# Altium schematic sheet 0222_GPU POWER_ VCCGT.SchDoc
size 848 x 558 mm
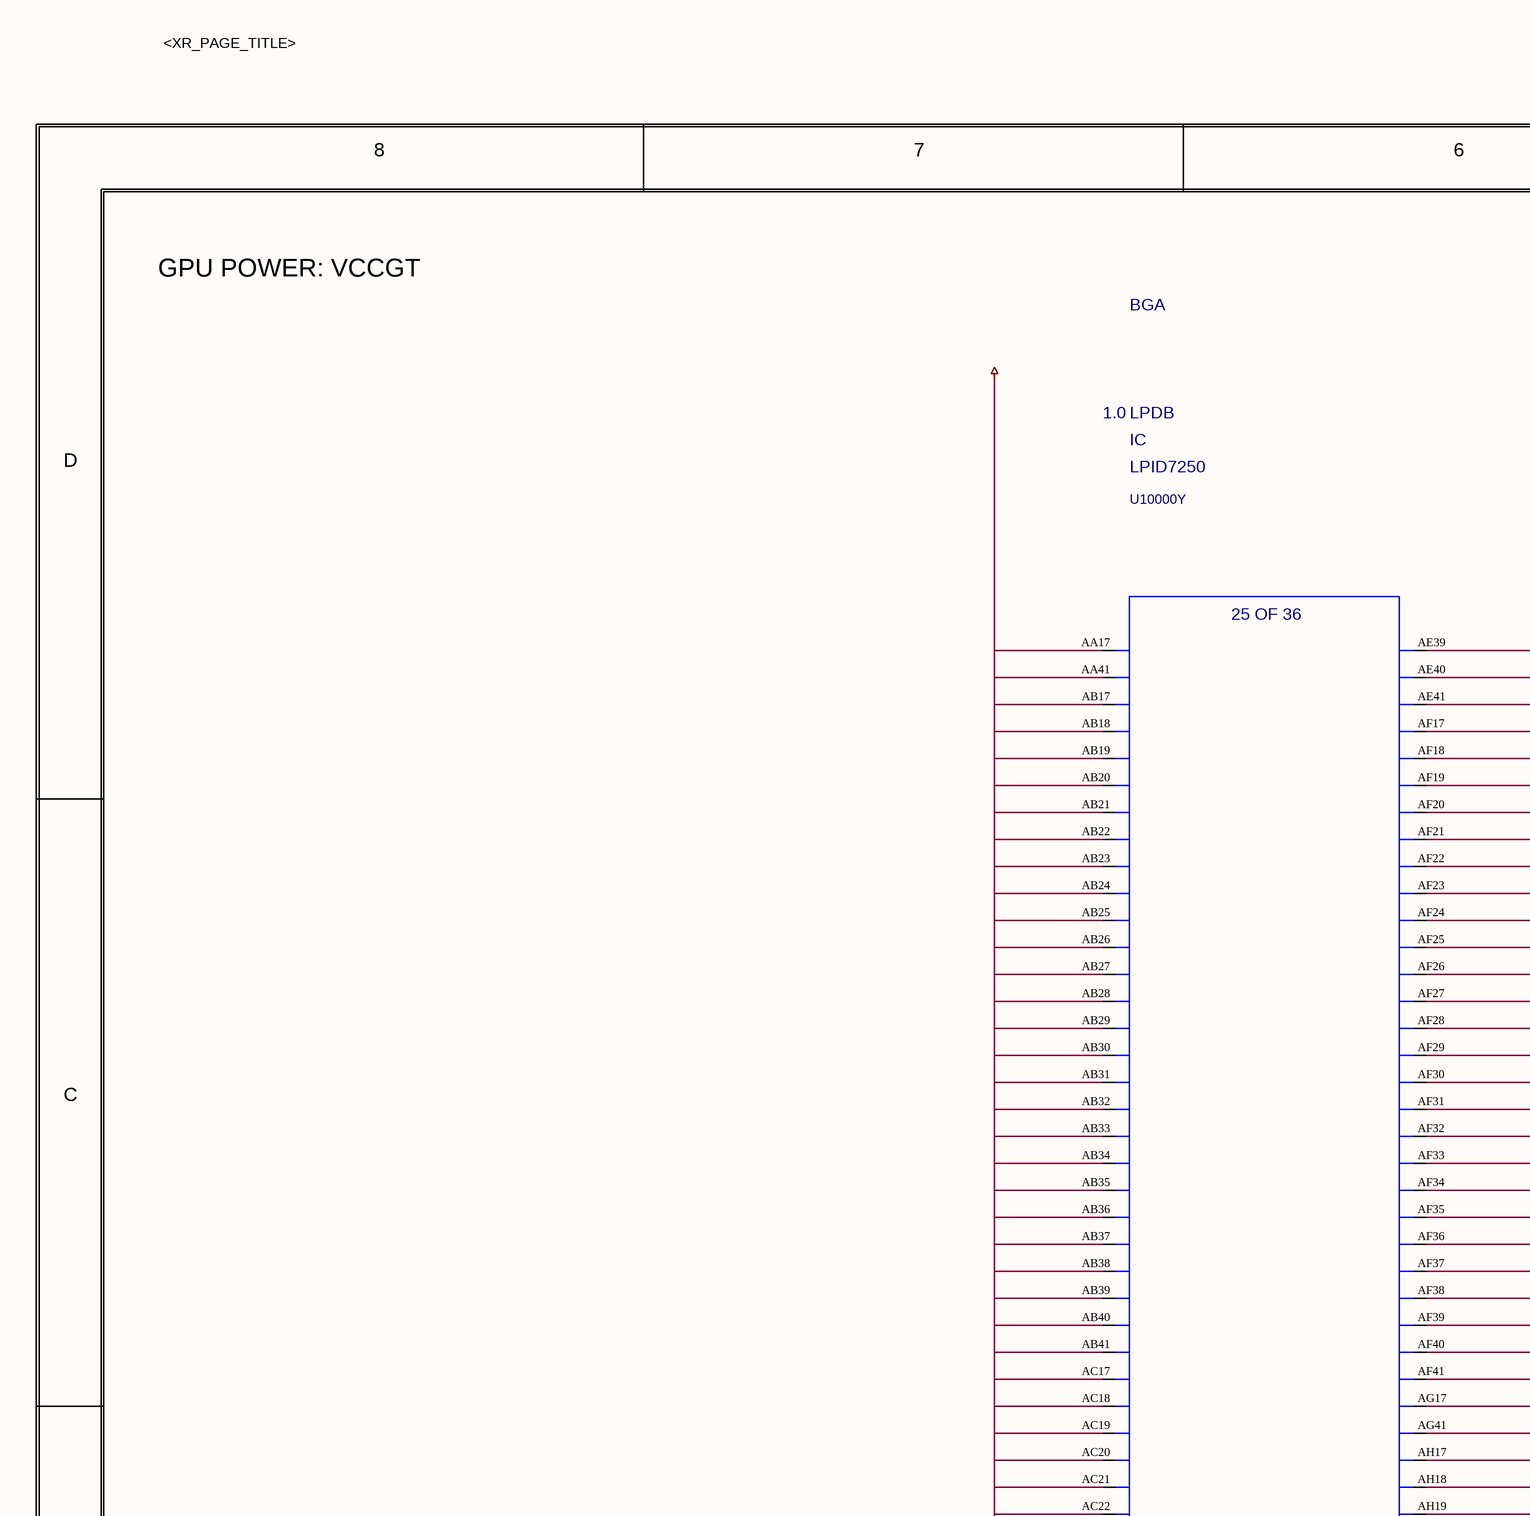
[diagram p0: 0222_GPU POWER_ VCCGT.SchDoc, top left]
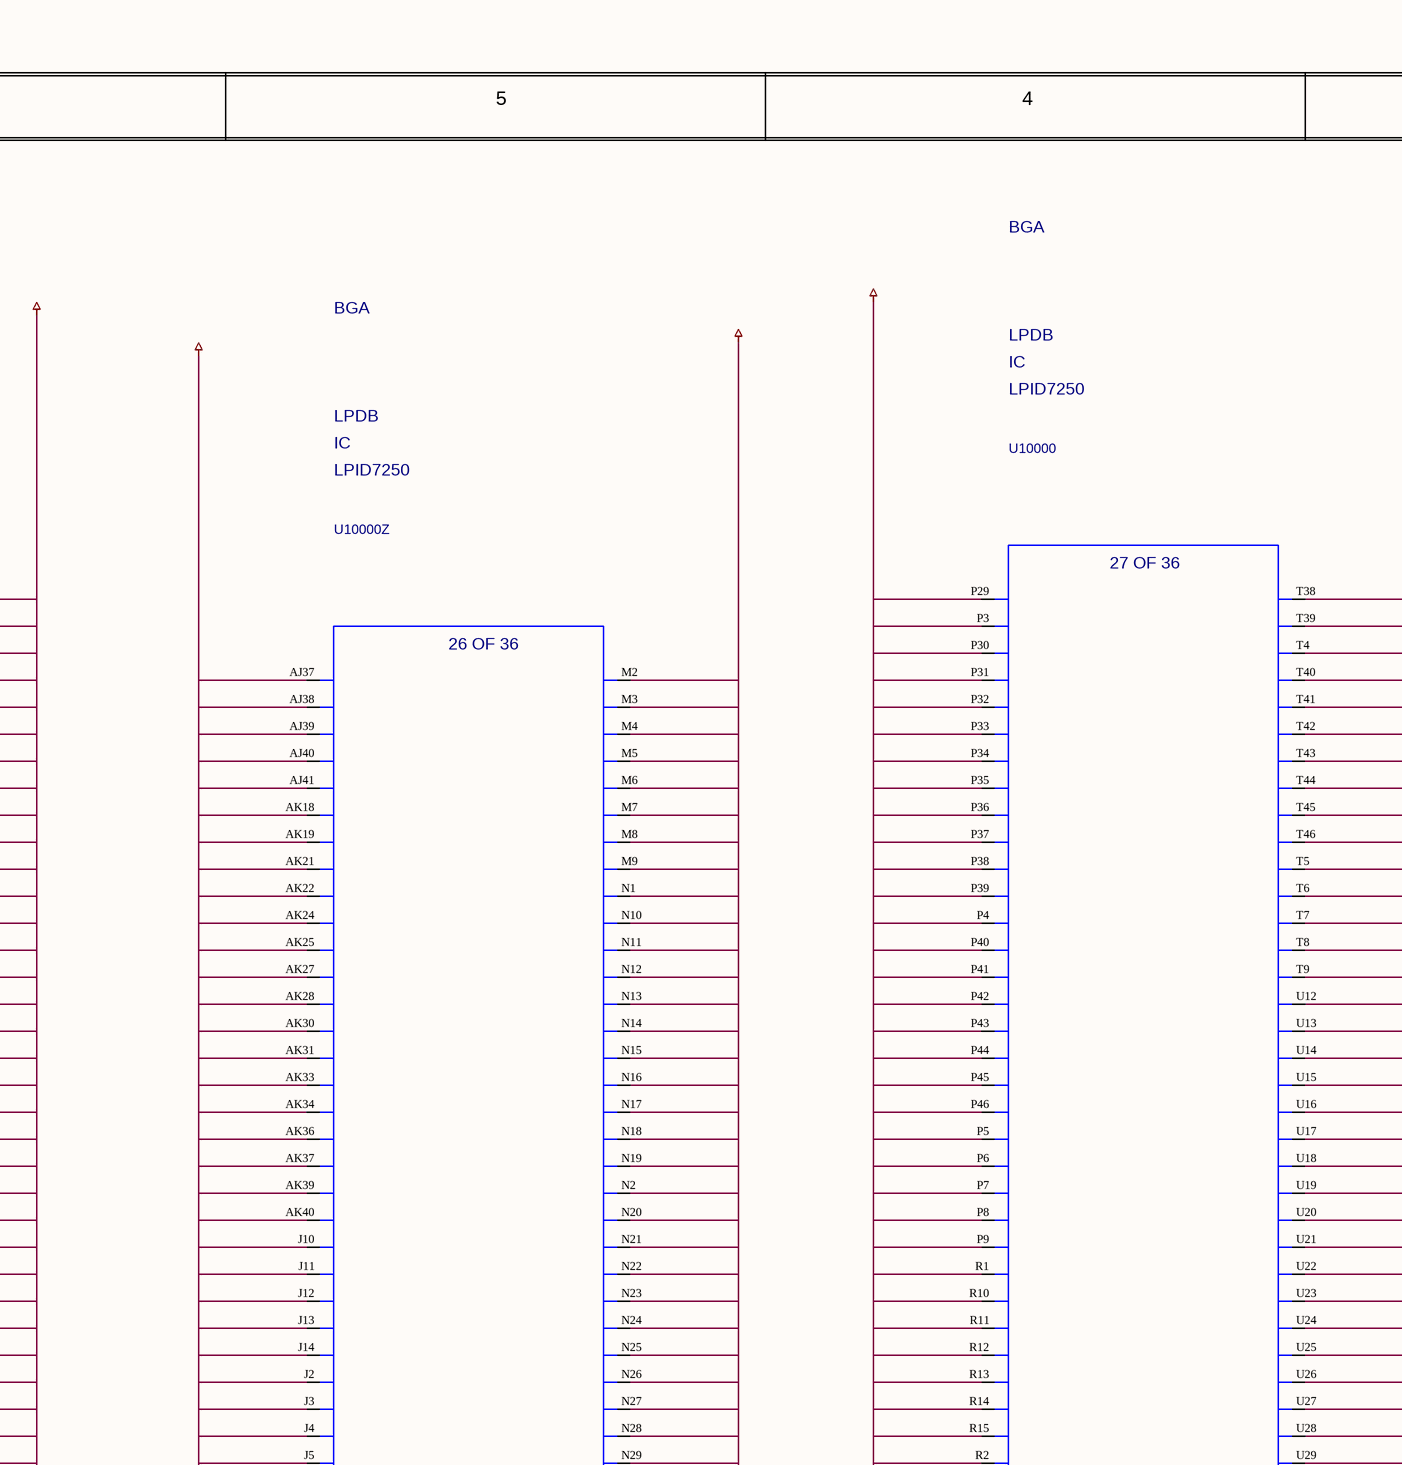
[diagram p1: 0222_GPU POWER_ VCCGT.SchDoc, top middle]
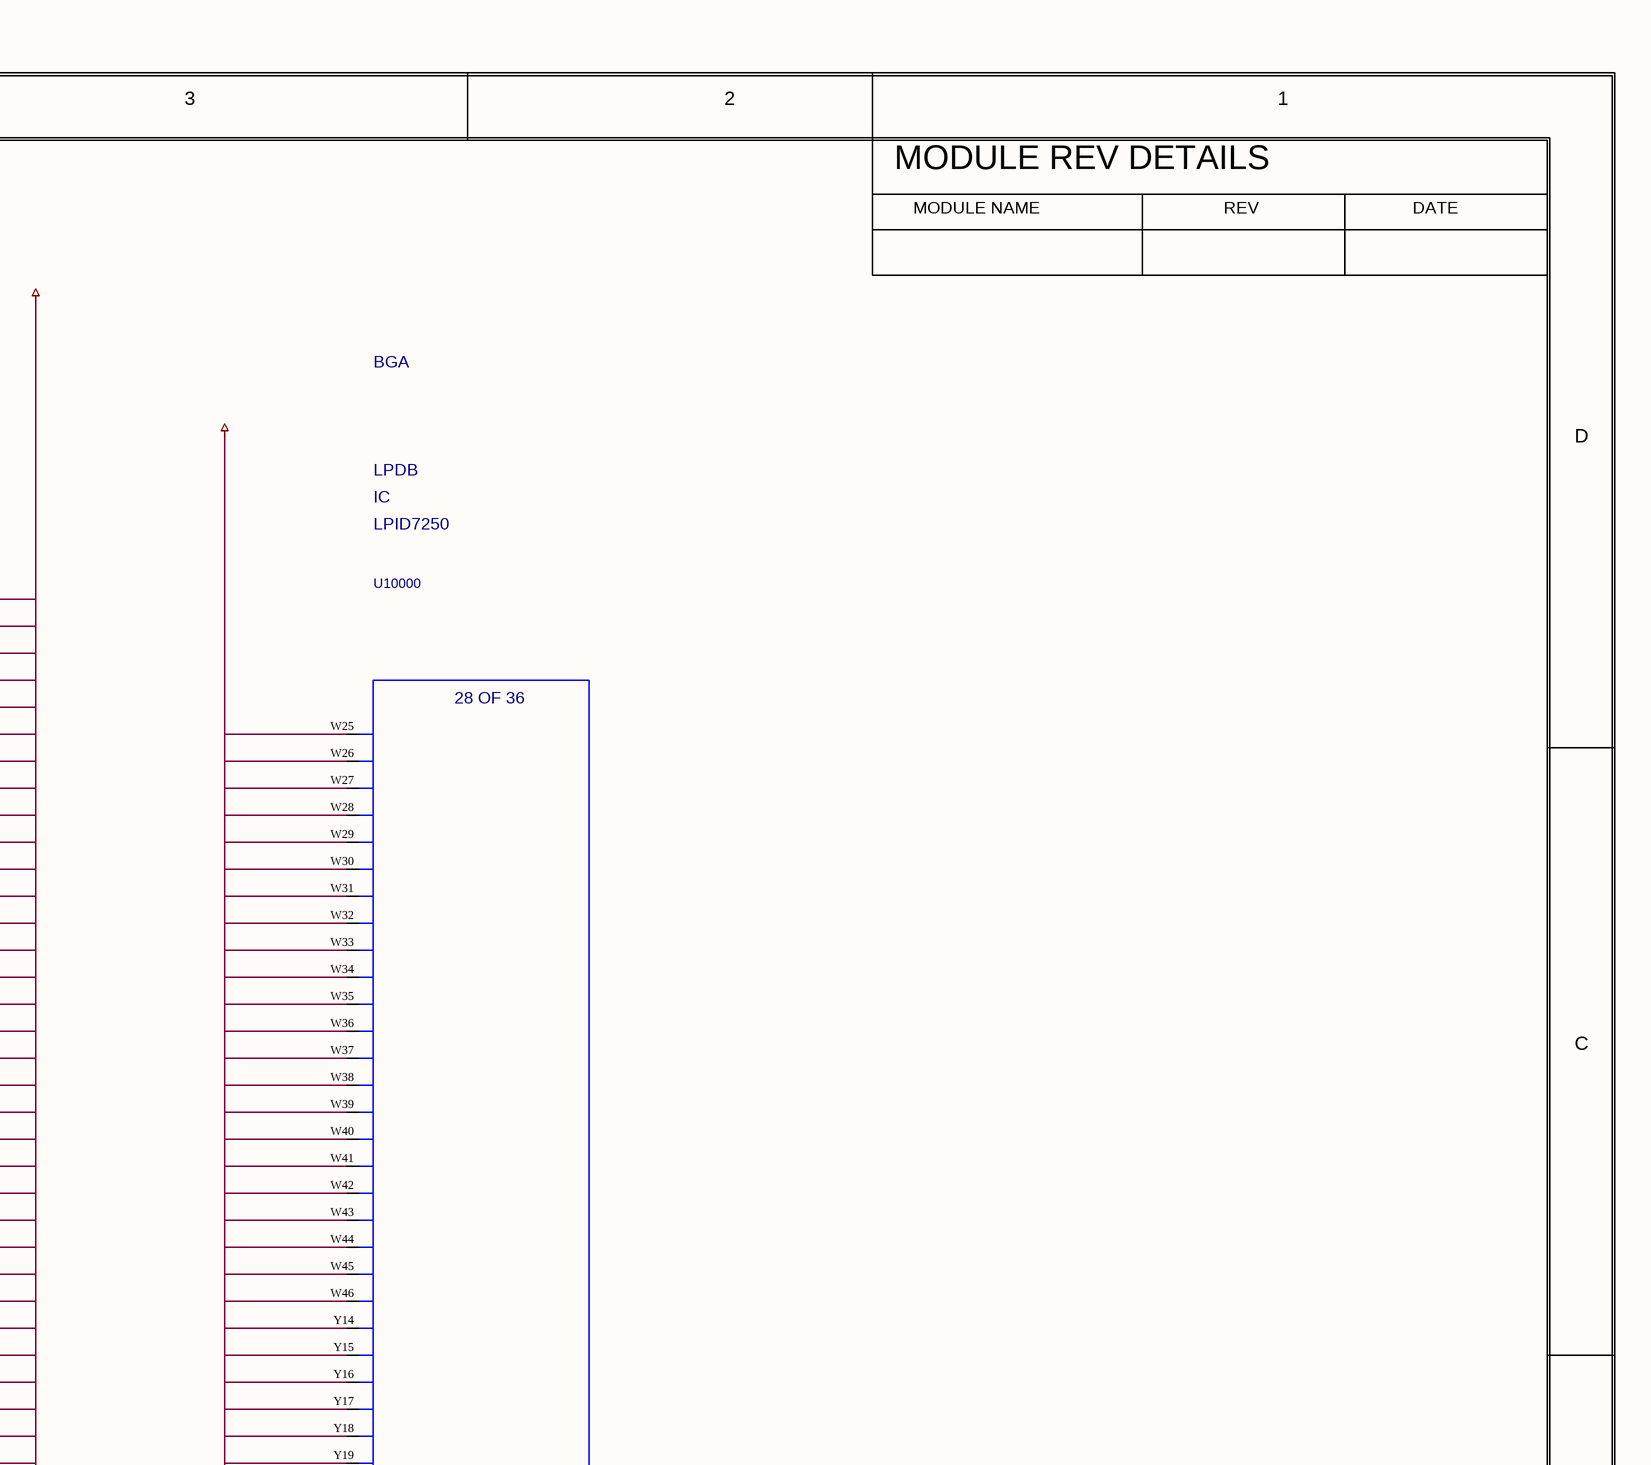
[diagram p2: 0222_GPU POWER_ VCCGT.SchDoc, top right]
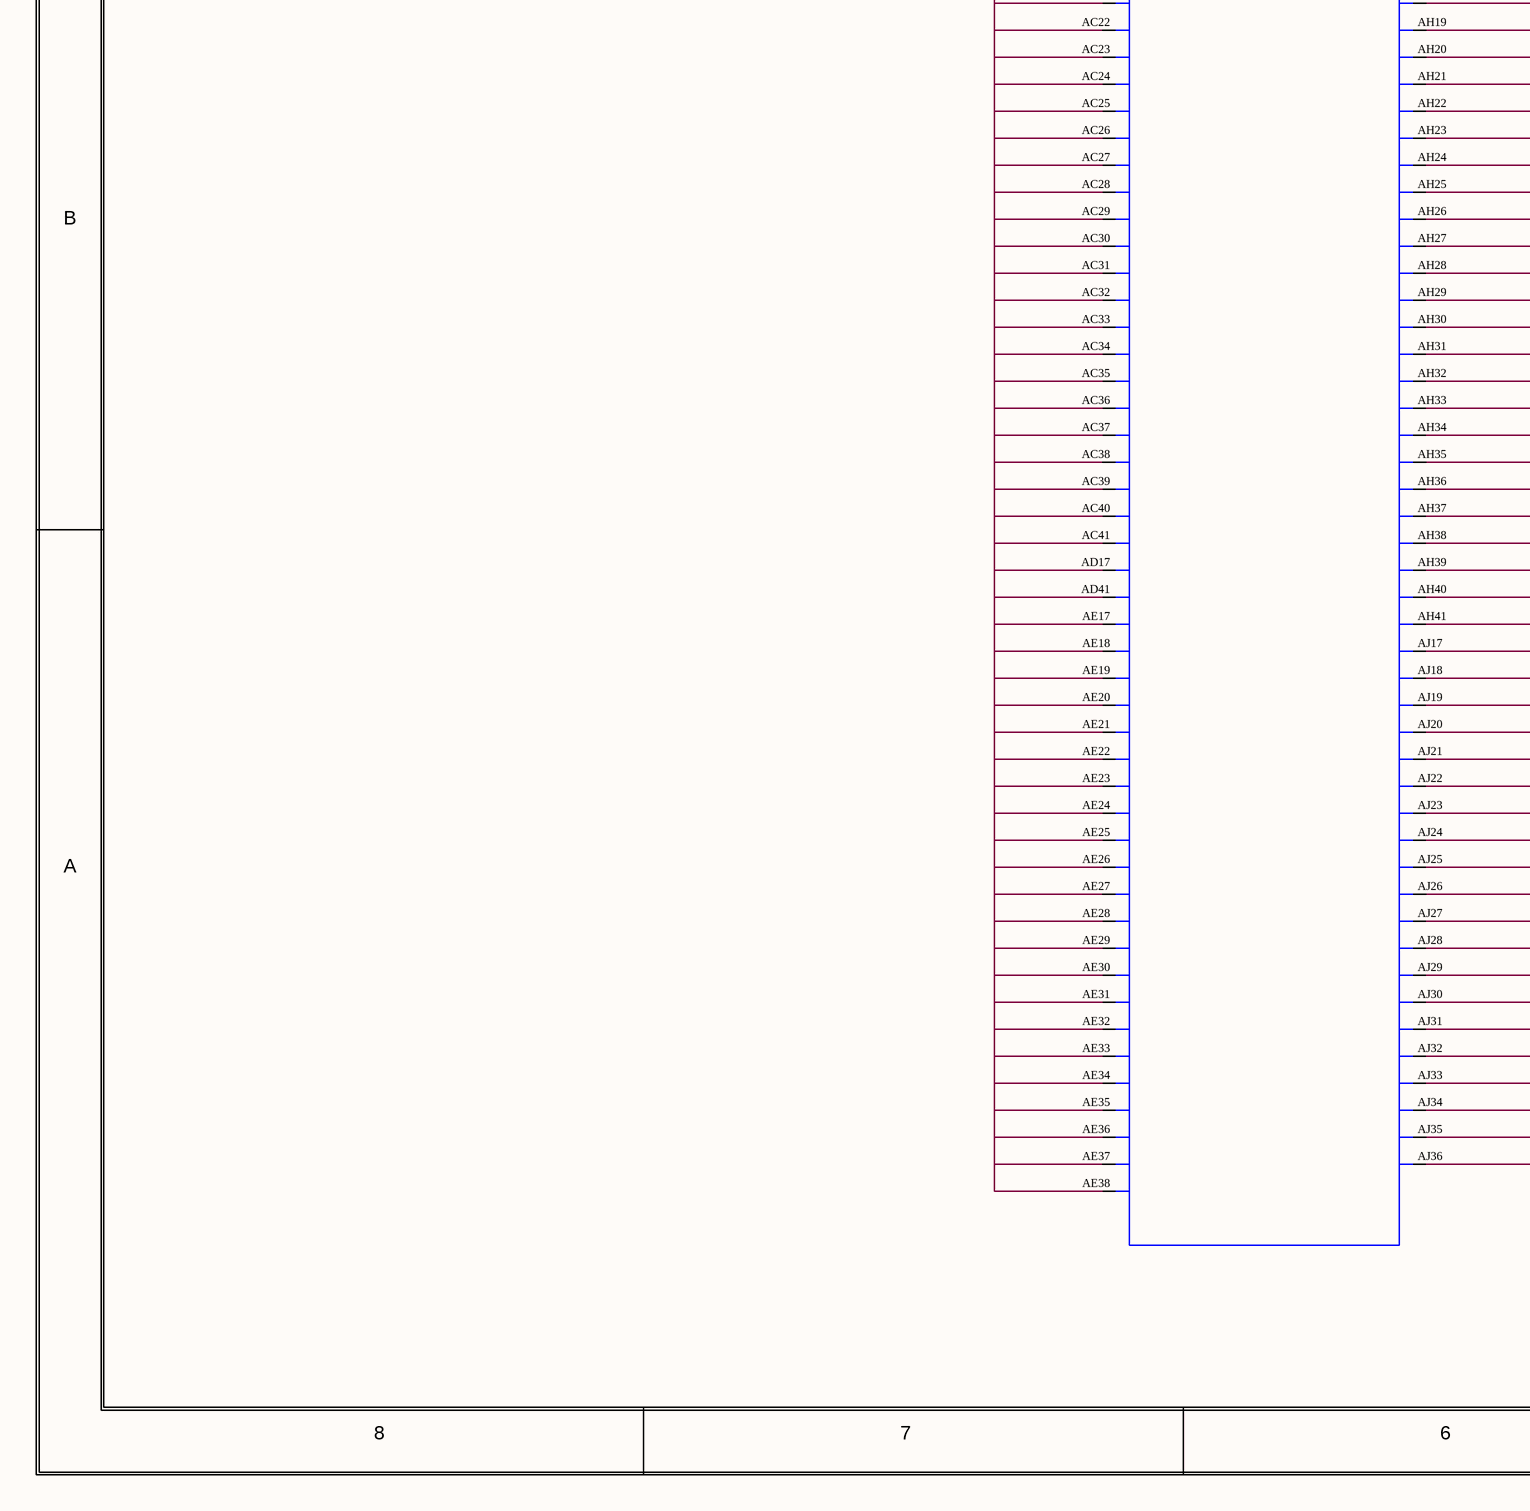
[diagram p3: 0222_GPU POWER_ VCCGT.SchDoc, bottom left]
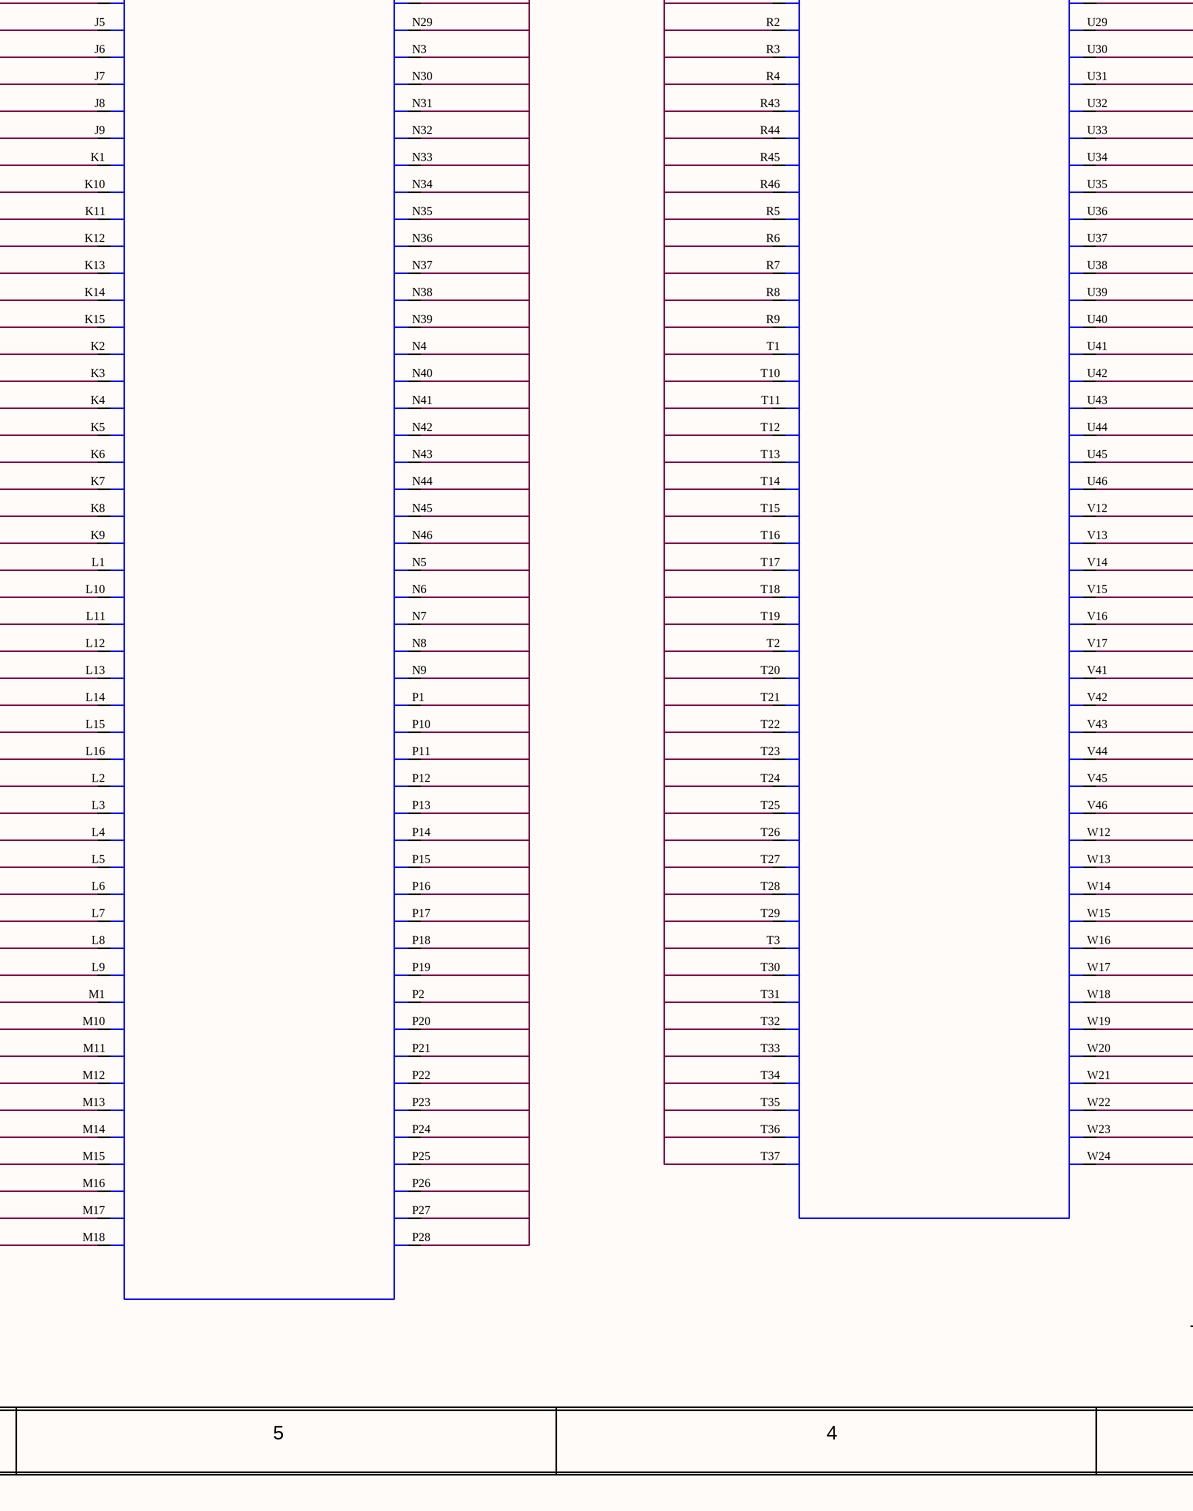
[diagram p4: 0222_GPU POWER_ VCCGT.SchDoc, bottom middle]
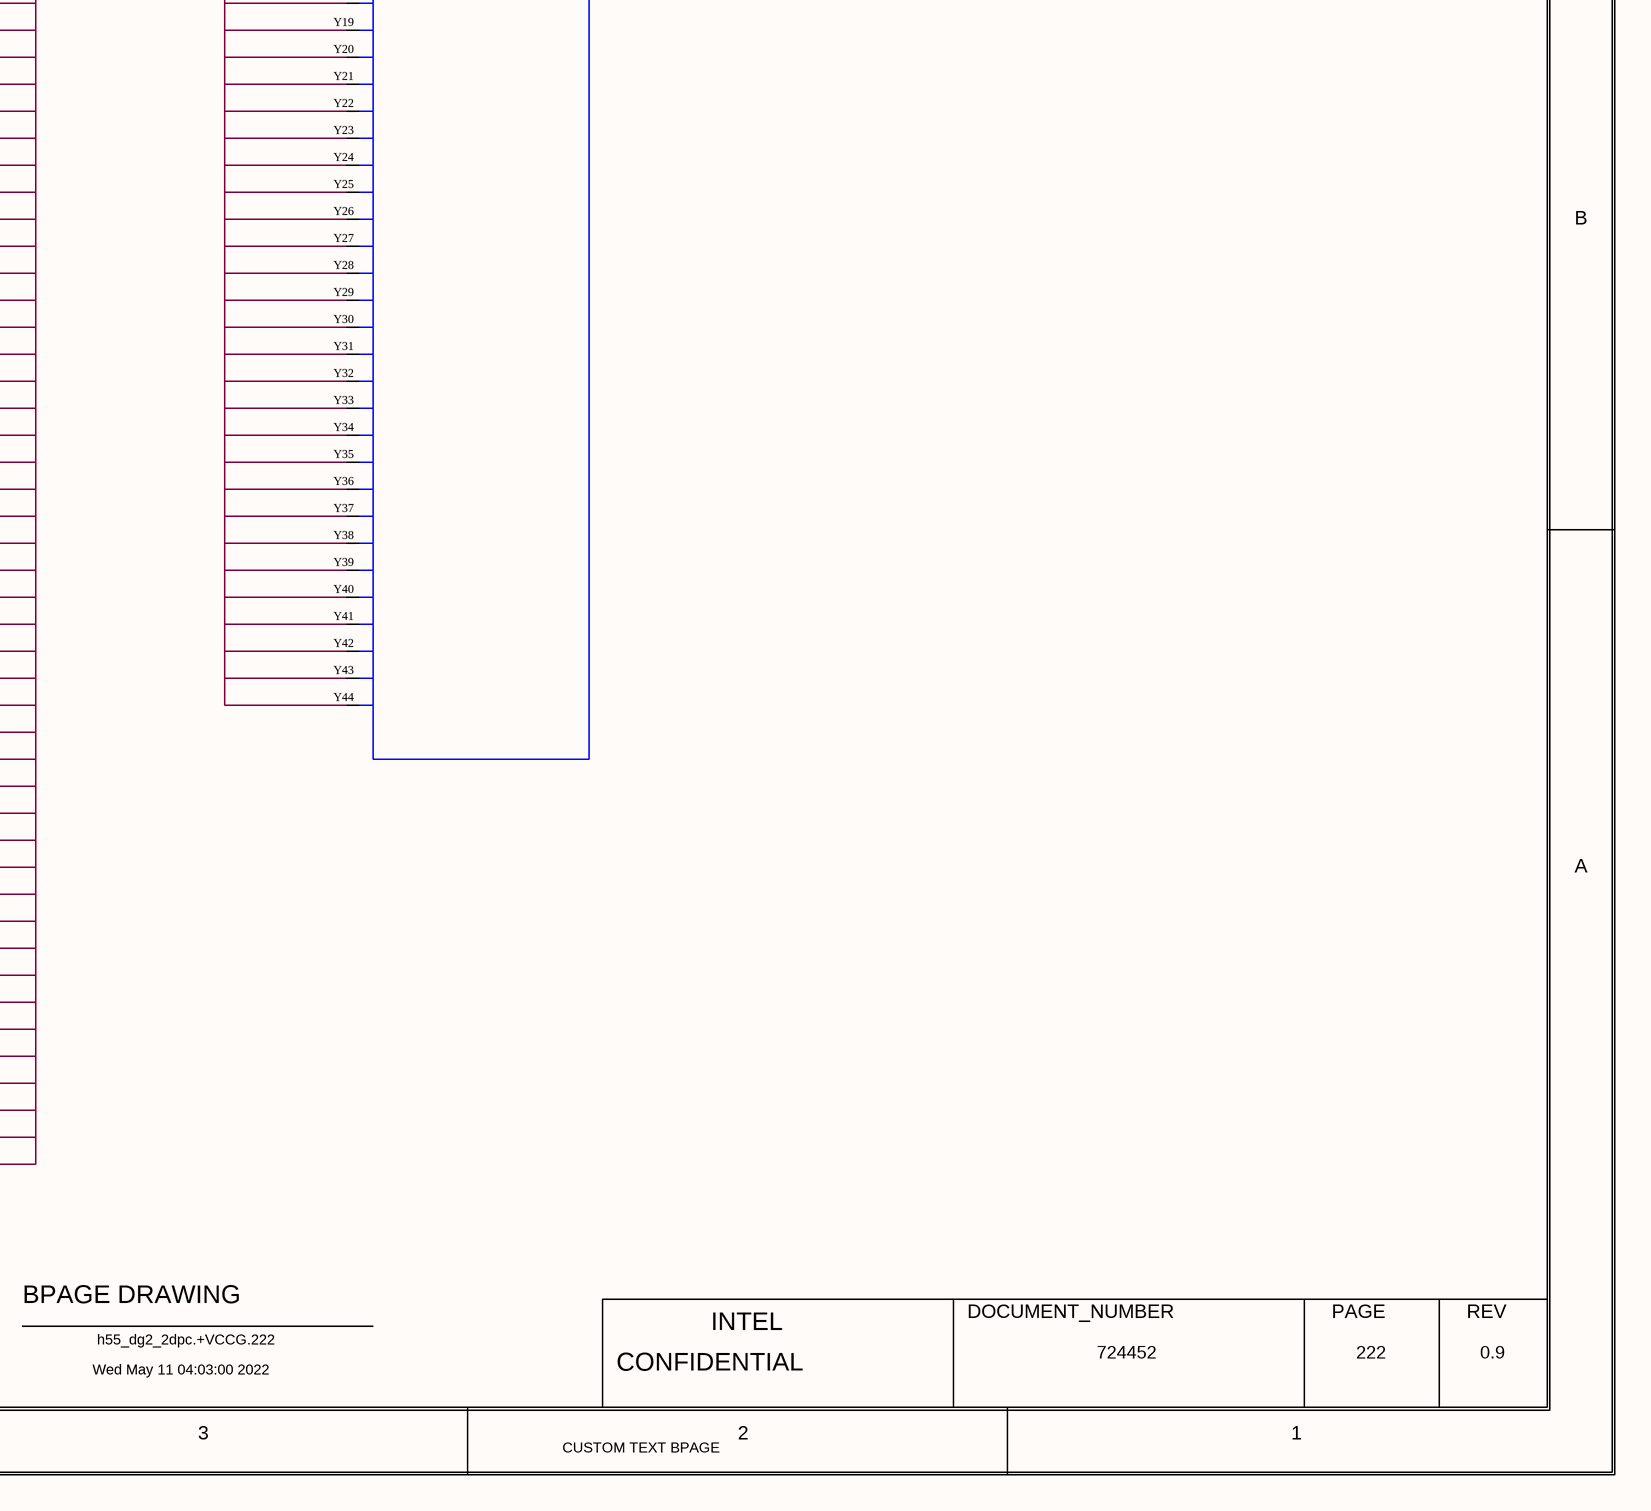
[diagram p5: 0222_GPU POWER_ VCCGT.SchDoc, bottom right]

## Parts
U10000  PART_NUMBER: LPID7250  PACK_TYPE: BGA  MATERIAL: IC  FP_TECH: LPDB  BMAP_REV: 1.0  [CLPDB_BGA2660_DG2_SVC_512_LP7250_MA]  (hidden comment: DG2_IP_NB_SKU1_SKU2_SKU3_EXT)  (parts Y,Z,27,28 of 36)

## Nets
+VCCGT_GPU: U10000.AA17(VCCGT_354) U10000.AA41(VCCGT_355) U10000.AB17(VCCGT_356) U10000.AB18(VCCGT_357) U10000.AB19(VCCGT_358) U10000.AB20(VCCGT_359) U10000.AB21(VCCGT_360) U10000.AB22(VCCGT_361) U10000.AB23(VCCGT_362) U10000.AB24(VCCGT_363) U10000.AB25(VCCGT_364) U10000.AB26(VCCGT_365) U10000.AB27(VCCGT_366) U10000.AB28(VCCGT_367) U10000.AB29(VCCGT_368) U10000.AB30(VCCGT_369) U10000.AB31(VCCGT_370) U10000.AB32(VCCGT_371) U10000.AB33(VCCGT_372) U10000.AB34(VCCGT_373) U10000.AB35(VCCGT_374) U10000.AB36(VCCGT_375) U10000.AB37(VCCGT_376) U10000.AB38(VCCGT_377) U10000.AB39(VCCGT_378) U10000.AB40(VCCGT_379) U10000.AB41(VCCGT_380) U10000.AC17(VCCGT_381) U10000.AC18(VCCGT_382) U10000.AC19(VCCGT_383) U10000.AC20(VCCGT_384) U10000.AC21(VCCGT_385) U10000.AC22(VCCGT_386) U10000.AC23(VCCGT_387) U10000.AC24(VCCGT_388) U10000.AC25(VCCGT_389) U10000.AC26(VCCGT_390) U10000.AC27(VCCGT_391) U10000.AC28(VCCGT_392) U10000.AC29(VCCGT_393) U10000.AC30(VCCGT_394) U10000.AC31(VCCGT_395) U10000.AC32(VCCGT_396) U10000.AC33(VCCGT_397) U10000.AC34(VCCGT_398) U10000.AC35(VCCGT_399) U10000.AC36(VCCGT_400) U10000.AC37(VCCGT_401) U10000.AC38(VCCGT_402) U10000.AC39(VCCGT_403) U10000.AC40(VCCGT_404) U10000.AC41(VCCGT_405) U10000.AD17(VCCGT_406) U10000.AD41(VCCGT_407) U10000.AE17(VCCGT_408) U10000.AE18(VCCGT_409) U10000.AE19(VCCGT_410) U10000.AE20(VCCGT_411) U10000.AE21(VCCGT_412) U10000.AE22(VCCGT_413) U10000.AE23(VCCGT_414) U10000.AE24(VCCGT_415) U10000.AE25(VCCGT_416) U10000.AE26(VCCGT_417) U10000.AE27(VCCGT_418) U10000.AE28(VCCGT_419) U10000.AE29(VCCGT_420) U10000.AE30(VCCGT_421) U10000.AE31(VCCGT_422) U10000.AE32(VCCGT_423) U10000.AE33(VCCGT_424) U10000.AE34(VCCGT_425) U10000.AE35(VCCGT_426) U10000.AE36(VCCGT_427) U10000.AE37(VCCGT_428) U10000.AE38(VCCGT_429) U10000.AE39(VCCGT_430) U10000.AE40(VCCGT_431) U10000.AE41(VCCGT_432) U10000.AF17(VCCGT_433) U10000.AF18(VCCGT_434) U10000.AF19(VCCGT_435) U10000.AF20(VCCGT_436) U10000.AF21(VCCGT_437) U10000.AF22(VCCGT_438) U10000.AF23(VCCGT_439) U10000.AF24(VCCGT_440) U10000.AF25(VCCGT_441) U10000.AF26(VCCGT_442) U10000.AF27(VCCGT_443) U10000.AF28(VCCGT_444) U10000.AF29(VCCGT_445) U10000.AF30(VCCGT_446) U10000.AF31(VCCGT_447) U10000.AF32(VCCGT_448) U10000.AF33(VCCGT_449) U10000.AF34(VCCGT_450) U10000.AF35(VCCGT_451) U10000.AF36(VCCGT_452) U10000.AF37(VCCGT_453) U10000.AF38(VCCGT_454) U10000.AF39(VCCGT_455) U10000.AF40(VCCGT_456) U10000.AF41(VCCGT_457) U10000.AG17(VCCGT_458) U10000.AG41(VCCGT_459) U10000.AH17(VCCGT_460) U10000.AH18(VCCGT_461) U10000.AH19(VCCGT_462) U10000.AH20(VCCGT_463) U10000.AH21(VCCGT_464) U10000.AH22(VCCGT_465) U10000.AH23(VCCGT_466) U10000.AH24(VCCGT_467) U10000.AH25(VCCGT_468) U10000.AH26(VCCGT_469) U10000.AH27(VCCGT_470) U10000.AH28(VCCGT_471) U10000.AH29(VCCGT_472) U10000.AH30(VCCGT_473) U10000.AH31(VCCGT_474) U10000.AH32(VCCGT_475) U10000.AH33(VCCGT_476) U10000.AH34(VCCGT_477) U10000.AH35(VCCGT_478) U10000.AH36(VCCGT_479) U10000.AH37(VCCGT_480) U10000.AH38(VCCGT_481) U10000.AH39(VCCGT_482) U10000.AH40(VCCGT_483) U10000.AH41(VCCGT_484) U10000.AJ17(VCCGT_485) U10000.AJ18(VCCGT_486) U10000.AJ19(VCCGT_487) U10000.AJ20(VCCGT_488) U10000.AJ21(VCCGT_489) U10000.AJ22(VCCGT_490) U10000.AJ23(VCCGT_491) U10000.AJ24(VCCGT_492) U10000.AJ25(VCCGT_493) U10000.AJ26(VCCGT_494) U10000.AJ27(VCCGT_495) U10000.AJ28(VCCGT_496) U10000.AJ29(VCCGT_497) U10000.AJ30(VCCGT_498) U10000.AJ31(VCCGT_499) U10000.AJ32(VCCGT_500) U10000.AJ33(VCCGT_501) U10000.AJ34(VCCGT_502) U10000.AJ35(VCCGT_503) U10000.AJ36(VCCGT_504) U10000.AJ37(VCCGT_204) U10000.AJ38(VCCGT_205) U10000.AJ39(VCCGT_206) U10000.AJ40(VCCGT_207) U10000.AJ41(VCCGT_208) U10000.AK18(VCCGT_209) U10000.AK19(VCCGT_210) U10000.AK21(VCCGT_211) U10000.AK22(VCCGT_212) U10000.AK24(VCCGT_213) U10000.AK25(VCCGT_214) U10000.AK27(VCCGT_215) U10000.AK28(VCCGT_216) U10000.AK30(VCCGT_217) U10000.AK31(VCCGT_218) U10000.AK33(VCCGT_219) U10000.AK34(VCCGT_220) U10000.AK36(VCCGT_221) U10000.AK37(VCCGT_222) U10000.AK39(VCCGT_223) U10000.AK40(VCCGT_224) U10000.J2(VCCGT_230) U10000.J3(VCCGT_231) U10000.J4(VCCGT_232) U10000.J5(VCCGT_233) U10000.J6(VCCGT_234) U10000.J7(VCCGT_235) U10000.J8(VCCGT_236) U10000.J9(VCCGT_237) U10000.J10(VCCGT_225) U10000.J11(VCCGT_226) U10000.J12(VCCGT_227) U10000.J13(VCCGT_228) U10000.J14(VCCGT_229) U10000.K1(VCCGT_238) U10000.K2(VCCGT_245) U10000.K3(VCCGT_246) U10000.K4(VCCGT_247) U10000.K5(VCCGT_248) U10000.K6(VCCGT_249) U10000.K7(VCCGT_250) U10000.K8(VCCGT_251) U10000.K9(VCCGT_252) U10000.K10(VCCGT_239) U10000.K11(VCCGT_240) U10000.K12(VCCGT_241) U10000.K13(VCCGT_242) U10000.K14(VCCGT_243) U10000.K15(VCCGT_244) U10000.L1(VCCGT_253) U10000.L2(VCCGT_261) U10000.L3(VCCGT_262) U10000.L4(VCCGT_263) U10000.L5(VCCGT_264) U10000.L6(VCCGT_265) U10000.L7(VCCGT_266) U10000.L8(VCCGT_267) U10000.L9(VCCGT_268) U10000.L10(VCCGT_254) U10000.L11(VCCGT_255) U10000.L12(VCCGT_256) U10000.L13(VCCGT_257) U10000.L14(VCCGT_258) U10000.L15(VCCGT_259) U10000.L16(VCCGT_260) U10000.M1(VCCGT_269) U10000.M2(VCCGT_279) U10000.M3(VCCGT_280) U10000.M4(VCCGT_281) U10000.M5(VCCGT_282) U10000.M6(VCCGT_283) U10000.M7(VCCGT_284) U10000.M8(VCCGT_285) U10000.M9(VCCGT_286) U10000.M10(VCCGT_270) U10000.M11(VCCGT_271) U10000.M12(VCCGT_272) U10000.M13(VCCGT_273) U10000.M14(VCCGT_274) U10000.M15(VCCGT_275) U10000.M16(VCCGT_276) U10000.M17(VCCGT_277) U10000.M18(VCCGT_278) U10000.N1(VCCGT_287) U10000.N2(VCCGT_298) U10000.N3(VCCGT_309) U10000.N4(VCCGT_320) U10000.N5(VCCGT_328) U10000.N6(VCCGT_329) U10000.N7(VCCGT_330) U10000.N8(VCCGT_331) U10000.N9(VCCGT_332) U10000.N10(VCCGT_288) U10000.N11(VCCGT_289) U10000.N12(VCCGT_290) U10000.N13(VCCGT_291) U10000.N14(VCCGT_292) U10000.N15(VCCGT_293) U10000.N16(VCCGT_294) U10000.N17(VCCGT_295) U10000.N18(VCCGT_296) U10000.N19(VCCGT_297) U10000.N20(VCCGT_299) U10000.N21(VCCGT_300) U10000.N22(VCCGT_301) U10000.N23(VCCGT_302) U10000.N24(VCCGT_303) U10000.N25(VCCGT_304) U10000.N26(VCCGT_305) U10000.N27(VCCGT_306) U10000.N28(VCCGT_307) U10000.N29(VCCGT_308) U10000.N30(VCCGT_310) U10000.N31(VCCGT_311) U10000.N32(VCCGT_312) U10000.N33(VCCGT_313) U10000.N34(VCCGT_314) U10000.N35(VCCGT_315) U10000.N36(VCCGT_316) U10000.N37(VCCGT_317) U10000.N38(VCCGT_318) U10000.N39(VCCGT_319) U10000.N40(VCCGT_321) U10000.N41(VCCGT_322) U10000.N42(VCCGT_323) U10000.N43(VCCGT_324) U10000.N44(VCCGT_325) U10000.N45(VCCGT_326) U10000.N46(VCCGT_327) U10000.P1(VCCGT_333) U10000.P2(VCCGT_344) U10000.P3(VCCGT_55) U10000.P4(VCCGT_66) U10000.P5(VCCGT_74) U10000.P6(VCCGT_75) U10000.P7(VCCGT_76) U10000.P8(VCCGT_77) U10000.P9(VCCGT_78) U10000.P10(VCCGT_334) U10000.P11(VCCGT_335) U10000.P12(VCCGT_336) U10000.P13(VCCGT_337) U10000.P14(VCCGT_338) U10000.P15(VCCGT_339) U10000.P16(VCCGT_340) U10000.P17(VCCGT_341) U10000.P18(VCCGT_342) U10000.P19(VCCGT_343) U10000.P20(VCCGT_345) U10000.P21(VCCGT_346) U10000.P22(VCCGT_347) U10000.P23(VCCGT_348) U10000.P24(VCCGT_349) U10000.P25(VCCGT_350) U10000.P26(VCCGT_351) U10000.P27(VCCGT_352) U10000.P28(VCCGT_353) U10000.P29(VCCGT_54) U10000.P30(VCCGT_56) U10000.P31(VCCGT_57) U10000.P32(VCCGT_58) U10000.P33(VCCGT_59) U10000.P34(VCCGT_60) U10000.P35(VCCGT_61) U10000.P36(VCCGT_62) U10000.P37(VCCGT_63) U10000.P38(VCCGT_64) U10000.P39(VCCGT_65) U10000.P40(VCCGT_67) U10000.P41(VCCGT_68) U10000.P42(VCCGT_69) U10000.P43(VCCGT_70) U10000.P44(VCCGT_71) U10000.P45(VCCGT_72) U10000.P46(VCCGT_73) U10000.R1(VCCGT_79) U10000.R2(VCCGT_86) U10000.R3(VCCGT_87) U10000.R4(VCCGT_88) U10000.R5(VCCGT_93) U10000.R6(VCCGT_94) U10000.R7(VCCGT_95) U10000.R8(VCCGT_96) U10000.R9(VCCGT_97) U10000.R10(VCCGT_80) U10000.R11(VCCGT_81) U10000.R12(VCCGT_82) U10000.R13(VCCGT_83) U10000.R14(VCCGT_84) U10000.R15(VCCGT_85) U10000.R43(VCCGT_89) U10000.R44(VCCGT_90) U10000.R45(VCCGT_91) U10000.R46(VCCGT_92) U10000.T1(VCCGT_98) U10000.T2(VCCGT_109) U10000.T3(VCCGT_120) U10000.T4(VCCGT_131) U10000.T5(VCCGT_139) U10000.T6(VCCGT_140) U10000.T7(VCCGT_141) U10000.T8(VCCGT_142) U10000.T9(VCCGT_143) U10000.T10(VCCGT_99) U10000.T11(VCCGT_100) U10000.T12(VCCGT_101) U10000.T13(VCCGT_102) U10000.T14(VCCGT_103) U10000.T15(VCCGT_104) U10000.T16(VCCGT_105) U10000.T17(VCCGT_106) U10000.T18(VCCGT_107) U10000.T19(VCCGT_108) U10000.T20(VCCGT_110) U10000.T21(VCCGT_111) U10000.T22(VCCGT_112) U10000.T23(VCCGT_113) U10000.T24(VCCGT_114) U10000.T25(VCCGT_115) U10000.T26(VCCGT_116) U10000.T27(VCCGT_117) U10000.T28(VCCGT_118) U10000.T29(VCCGT_119) U10000.T30(VCCGT_121) U10000.T31(VCCGT_122) U10000.T32(VCCGT_123) U10000.T33(VCCGT_124) U10000.T34(VCCGT_125) U10000.T35(VCCGT_126) U10000.T36(VCCGT_127) U10000.T37(VCCGT_128) U10000.T38(VCCGT_129) U10000.T39(VCCGT_130) U10000.T40(VCCGT_132) U10000.T41(VCCGT_133) U10000.T42(VCCGT_134) U10000.T43(VCCGT_135) U10000.T44(VCCGT_136) U10000.T45(VCCGT_137) U10000.T46(VCCGT_138) U10000.U12(VCCGT_144) U10000.U13(VCCGT_145) U10000.U14(VCCGT_146) U10000.U15(VCCGT_147) U10000.U16(VCCGT_148) U10000.U17(VCCGT_149) U10000.U18(VCCGT_150) U10000.U19(VCCGT_151) U10000.U20(VCCGT_152) U10000.U21(VCCGT_153) U10000.U22(VCCGT_154) U10000.U23(VCCGT_155) U10000.U24(VCCGT_156) U10000.U25(VCCGT_157) U10000.U26(VCCGT_158) U10000.U27(VCCGT_159) U10000.U28(VCCGT_160) U10000.U29(VCCGT_161) U10000.U30(VCCGT_162) U10000.U31(VCCGT_163) U10000.U32(VCCGT_164) U10000.U33(VCCGT_165) U10000.U34(VCCGT_166) U10000.U35(VCCGT_167) U10000.U36(VCCGT_168) U10000.U37(VCCGT_169) U10000.U38(VCCGT_170) U10000.U39(VCCGT_171) U10000.U40(VCCGT_172) U10000.U41(VCCGT_173) U10000.U42(VCCGT_174) U10000.U43(VCCGT_175) U10000.U44(VCCGT_176) U10000.U45(VCCGT_177) U10000.U46(VCCGT_178) U10000.V12(VCCGT_179) U10000.V13(VCCGT_180) U10000.V14(VCCGT_181) U10000.V15(VCCGT_182) U10000.V16(VCCGT_183) U10000.V17(VCCGT_184) U10000.V41(VCCGT_185) U10000.V42(VCCGT_186) U10000.V43(VCCGT_187) U10000.V44(VCCGT_188) U10000.V45(VCCGT_189) U10000.V46(VCCGT_190) U10000.W12(VCCGT_191) U10000.W13(VCCGT_192) U10000.W14(VCCGT_193) U10000.W15(VCCGT_194) U10000.W16(VCCGT_195) U10000.W17(VCCGT_196) U10000.W18(VCCGT_197) U10000.W19(VCCGT_198) U10000.W20(VCCGT_199) U10000.W21(VCCGT_200) U10000.W22(VCCGT_201) U10000.W23(VCCGT_202) U10000.W24(VCCGT_203) U10000.W25(VCCGT_1) U10000.W26(VCCGT_2) U10000.W27(VCCGT_3) U10000.W28(VCCGT_4) U10000.W29(VCCGT_5) U10000.W30(VCCGT_6) U10000.W31(VCCGT_7) U10000.W32(VCCGT_8) U10000.W33(VCCGT_9) U10000.W34(VCCGT_10) U10000.W35(VCCGT_11) U10000.W36(VCCGT_12) U10000.W37(VCCGT_13) U10000.W38(VCCGT_14) U10000.W39(VCCGT_15) U10000.W40(VCCGT_16) U10000.W41(VCCGT_17) U10000.W42(VCCGT_18) U10000.W43(VCCGT_19) U10000.W44(VCCGT_20) U10000.W45(VCCGT_21) U10000.W46(VCCGT_22) U10000.Y14(VCCGT_23) U10000.Y15(VCCGT_24) U10000.Y16(VCCGT_25) U10000.Y17(VCCGT_26) U10000.Y18(VCCGT_27) U10000.Y19(VCCGT_28) U10000.Y20(VCCGT_29) U10000.Y21(VCCGT_30) U10000.Y22(VCCGT_31) U10000.Y23(VCCGT_32) U10000.Y24(VCCGT_33) U10000.Y25(VCCGT_34) U10000.Y26(VCCGT_35) U10000.Y27(VCCGT_36) U10000.Y28(VCCGT_37) U10000.Y29(VCCGT_38) U10000.Y30(VCCGT_39) U10000.Y31(VCCGT_40) U10000.Y32(VCCGT_41) U10000.Y33(VCCGT_42) U10000.Y34(VCCGT_43) U10000.Y35(VCCGT_44) U10000.Y36(VCCGT_45) U10000.Y37(VCCGT_46) U10000.Y38(VCCGT_47) U10000.Y39(VCCGT_48) U10000.Y40(VCCGT_49) U10000.Y41(VCCGT_50) U10000.Y42(VCCGT_51) U10000.Y43(VCCGT_52) U10000.Y44(VCCGT_53)

## Notes on the sheet
- <XR_PAGE_TITLE>
- 8
- 7
- 6
- 5
- 4
- 3
- 2
- 1
- MODULE REV DETAILS
- GPU POWER: VCCGT
- MODULE NAME
- REV
- DATE
- D
- C
- B
- A
- BPAGE DRAWING
- INTEL
- DOCUMENT_NUMBER
- PAGE
- Wed May 11 04:03:00 2022
- h55_dg2_2dpc.+VCCG.222
- CONFIDENTIAL
- 724452
- 222
- 0.9
- CUSTOM TEXT BPAGE
- (in symbol DG2_IP_NB_SKU1_SKU2_SKU3_EXT, part Y) 25 OF 36
- (in symbol DG2_IP_NB_SKU1_SKU2_SKU3_EXT, part Z) 26 OF 36
- (in symbol DG2_IP_NB_SKU1_SKU2_SKU3_EXT, part 27) 27 OF 36
- (in symbol DG2_IP_NB_SKU1_SKU2_SKU3_EXT, part 28) 28 OF 36

## Library data of the parts
U10000 = DG2_IP_NB_SKU1_SKU2_SKU3_EXT: MANUF: INTEL CORP; CDS_PHYS_PART_NAME: DG2_IP_NB_SKU1_SKU2_SKU3_EXT_BGA-LPID7250,IC,DG2_IP_NB_SKU1_SKUA; CDS_LMAN_SYM_OUTLINE: -300,850,300,-800; OriginalSymbolOrigin: (-325,850); CaptureCellPackProp: DG2_IP_NB_SKU1_SKU2_SKU3_EXTY; XY: (-4950,4000); VER: 25; ROT: 0; PHYS_PAGE: 222; MFG_PN: NONE; LOCATION: U10000; DRAWING: @RVP1_ADL_SB_ADP_S_DDR5_SODIMM_2DPC_LIB.H55_DG2_2DPC(SCH_1):PAGE393; CDS_LIB: rvp1_adl_sb_adp_s_ddr5_sodimm_2dpc_lib; PCB Footprint: CLPDB_BGA2660_DG2_SVC_512_LP7250_MA; SEC_TYPE: BGA; CHIPS_PART_NAME: DG2_IP_NB_SKU1_SKU2_SKU3_EXT; CDS_PART_NAME: DG2_IP_NB_SKU1_SKU2_SKU3_EXT_BGA-LPID7250,IC,DG2_IP_NB_SKU1_SKUA; CDS_LOCATION: U10000